# EasyEDA Pro project EP4CE144.eprj (continued)
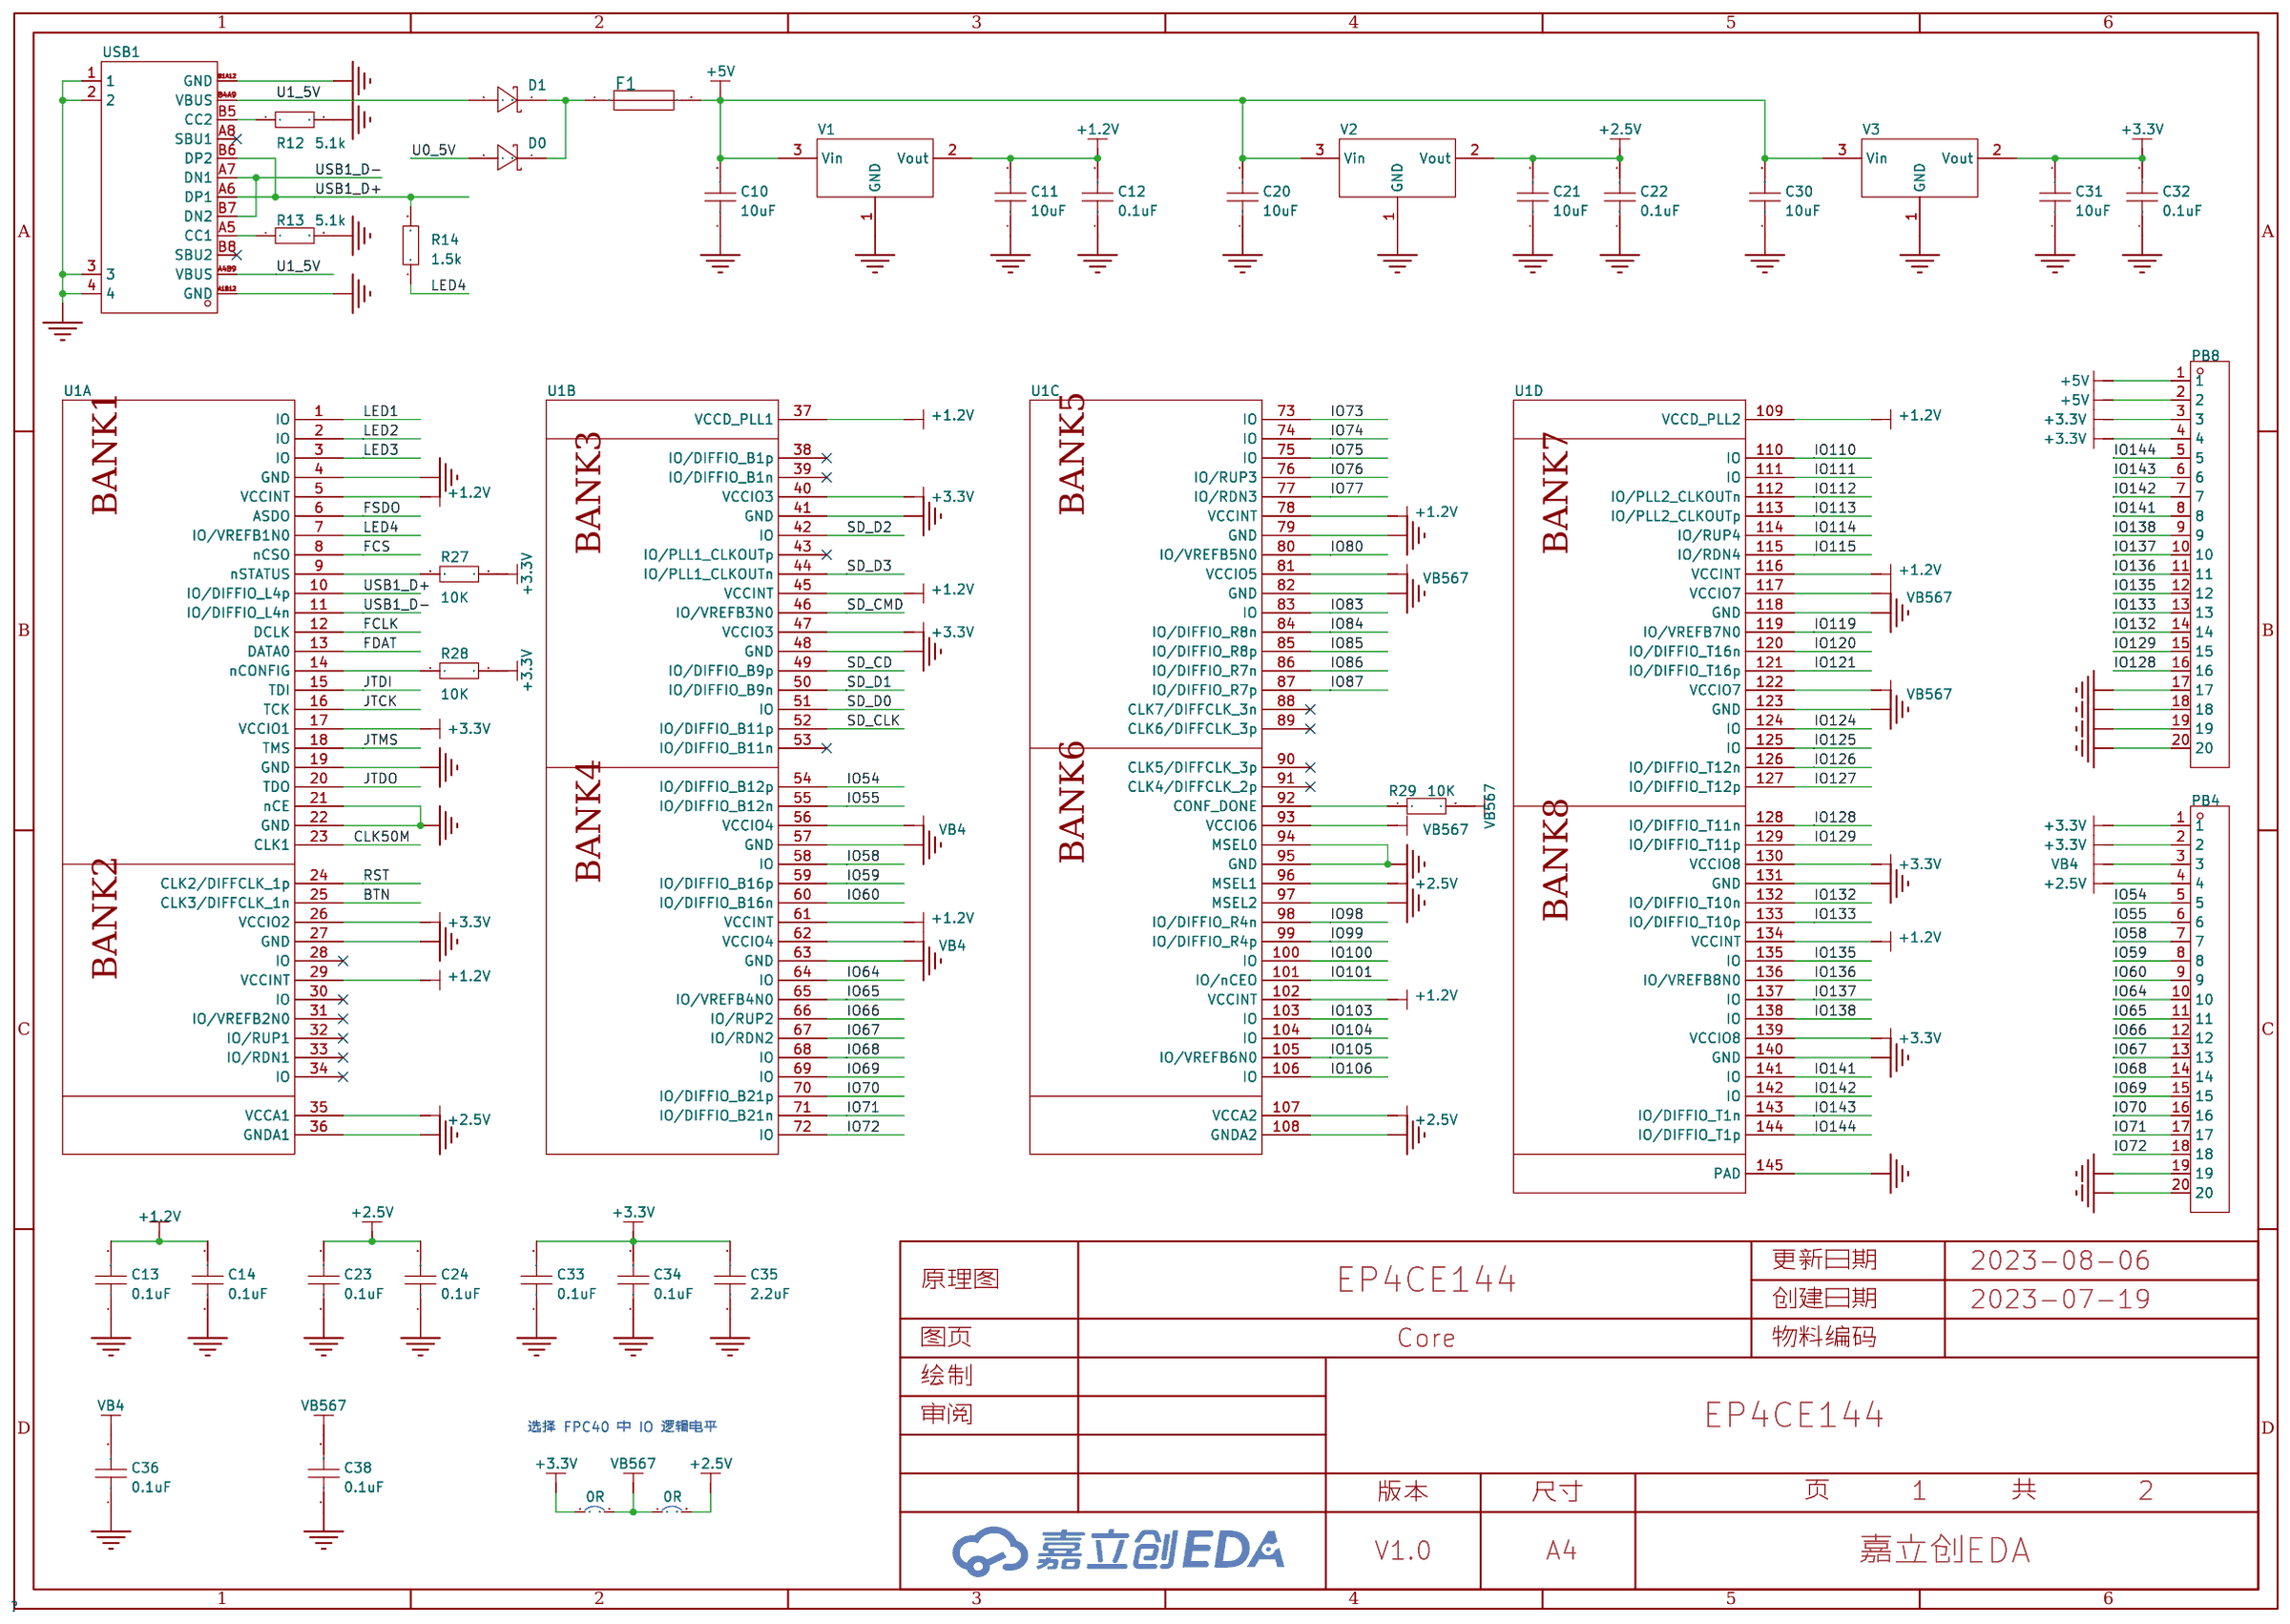
[diagram p0: Core]
## Notes on the sheets (continued)

Outline 60.96 x 45.72 mm; copper layers: Top Layer, Bottom Layer. Coordinates in mm from the lower left corner of the outline.
Outline path: 0,44.2 0,1.52 arc(0.45,0.45) 1.52,0 59.44,0 arc(60.51,0.45) 60.96,1.52 60.96,44.2 arc(60.51,45.27) 59.44,45.72 1.52,45.72 arc(0.45,45.27) 0,44.2
Stack: Top Layer 0.035mm / Dielectric1 1.51mm FR4 er 4.5 / Bottom Layer 0.035mm

## Design rules (mm)
spacing safeClearance (default): track to track 0.152, other pairs 0.152 to 0.3
track width trackWidth (default): min 0.127, default 0.254, max 2.54
differential pair differentialPair (default): width min 0.127, default 0.254, max 2.54; gap min 0.152, default 0.152
via viaSize (default): diameter min 0.5, default 0.61, max 10; hole min 0.3, default 0.305, max 6

## Placement (name value [footprint] x y rotation side)
BTN  PTS815SJK250SMTRLFS  [SW-SMD_4P-L4.2-W3.3-P2.15-LS5.1]  57.78 6.98 0 top
C1  0.1uF  [C0603]  13.21 19.43 0 top
C2  0.1uF  [C0603]  18.03 17.02 180 top
C5  2.2uF  [C0603]  48.77 24.13 90 bottom
C6  2.2uF  [C0603]  51.56 29.46 0 top
C7  2.2uF  [C0603]  51.56 27.56 0 top
C8  0.1uF  [C0603]  19.81 5.97 90 top
C9  1uF  [C0603]  18.03 5.97 90 top
C10  10uF  [C0603]  1.78 18.03 90 top
C11  10uF  [C0603]  1.78 14.99 90 top
C12  0.1uF  [C0603]  9.27 15.75 90 top
C13  0.1uF  [C0603]  24.13 6.98 90 top
C14  0.1uF  [C0603]  47.5 33.66 180 top
C20  10uF  [C0603]  1.78 24.38 90 top
C21  10uF  [C0603]  1.78 21.34 90 top
C22  0.1uF  [C0603]  9.27 22.1 90 top
C23  0.1uF  [C0603]  26.29 6.98 90 top
C24  0.1uF  [C0603]  48.26 31.88 180 top
C30  10uF  [C0603]  1.78 30.73 90 top
C31  10uF  [C0603]  1.78 27.69 90 top
C32  0.1uF  [C0603]  9.27 28.45 90 top
C33  0.1uF  [C0603]  21.97 6.98 90 top
C34  0.1uF  [C0603]  28.45 6.98 90 top
C35  2.2uF  [C0603]  23.24 38.61 0 top
C36  0.1uF  [C0603]  46.35 6.1 180 top
C38  0.1uF  [C0603]  46.35 7.87 180 top
D0  1N5818W  [SOD-123FL_L2.8-W1.8-LS3.7-RD]  9.27 12.7 270 bottom
D1  1N5818W  [SOD-123FL_L2.8-W1.8-LS3.7-RD]  9.27 33.02 90 bottom
F1  JK-nSMD050-30  [F1206]  7.75 22.86 180 bottom
FPC  AFC01-S40FCA-00  [FPC-SMD_P0.50-40P_FGS-XJ-H2.0]  56.26 28.19 270 top
J1  0R  [R0603]  57.91 31.88 90 bottom
J2  0R  [R0603]  57.91 34.92 90 bottom
JTAG  -  [LED0603-RD]  16.26 30.48 180 top
LED1  -  [LED0603-RD_BLUE]  16.26 38.61 180 top
LED2  -  [LED0603-RD_BLUE]  16.26 36.58 180 top
LED3  -  [LED0603-RD_BLUE]  16.26 34.54 180 top
LED4  -  [LED0603-RD_BLUE]  16.26 32.51 180 top
NOREF  -  [Pad_e58]  34.29 22.86 0 top
PB4  -  [HDR-TH_20P-P2.54-V-M-1]  35.56 1.27 0 top
PB8  -  [HDR-TH_20P-P2.54-V-M-1]  35.56 44.32 0 top
PWR  -  [LED0603-RD_BLUE]  16.26 28.45 180 top
R0  1k  [R0603]  12.7 28.45 180 top
R1  1k  [R0603]  12.7 30.48 180 top
R2  1k  [R0603]  12.7 38.61 180 top
R3  1k  [R0603]  12.7 36.58 180 top
R4  1k  [R0603]  12.7 34.54 180 top
R5  1k  [R0603]  12.7 32.51 180 top
R6  10k  [R0603]  46.35 11.05 180 top
R7  10k  [R0603]  46.35 9.53 180 top
R8  10k  [R0603]  19.81 9.02 90 top
R9  10k  [R0603]  18.03 9.02 90 top
R10  5.1k  [R0603]  6.1 1.02 0 top
R11  5.1k  [R0603]  3.05 1.02 180 top
R12  5.1k  [R0603]  3.05 44.7 180 top
R13  5.1k  [R0603]  6.1 44.7 0 top
R14  1.5k  [R0603]  11.94 32.51 270 bottom
R17  200  [R0603]  14.22 13.97 270 top
R18  200  [R0603]  12.7 13.97 270 top
R19  200  [R0603]  11.18 13.97 270 top
R20  47k  [R0603]  58.04 24.13 90 bottom
R21  47k  [R0603]  56.51 24.13 90 bottom
R22  47k  [R0603]  54.99 24.13 90 bottom
R23  47k  [R0603]  53.47 24.13 90 bottom
R24  47k  [R0603]  51.94 24.13 90 bottom
R25  47k  [R0603]  50.42 24.13 90 bottom
R27  10K  [R0603]  23.24 36.96 0 top
R28  10K  [R0603]  23.24 35.43 0 top
R29  10K  [R0603]  47.75 22.86 90 top
RST  PTS815SJK250SMTRLFS  [SW-SMD_4P-L4.2-W3.3-P2.15-LS5.1]  57.78 12.06 0 top
TF  TF-01  [TF-SMD_TF-02]  54.36 12.7 270 bottom
TPC  -  [TP]  12.7 8.89 180 bottom
TPD  -  [TP]  10.92 8.89 180 bottom
U0  -  [TSSOP-20_L6.5-W4.4-P0.65-LS6.4-BL]  13.46 8 180 top
U1  -  [EQFP-144_L20.0-W20.0-P0.50-LS22.0-TL-EP6.7]  34.29 22.86 0 top
U2  EPCS16  [SOIC-8_L4.9-W3.9-P1.27-LS6.0-BL]  15.62 23.24 270 top
USB0  USB-TYPE-C-017  [USB-TYPE-C-SMD_C9900008089]  4.95 6.98 270 top
USB1  USB-TYPE-C-017  [USB-TYPE-C-SMD_C9900008089]  4.95 38.73 270 top
V1  AMS1117-1.2 SOT-89  [SOT-89-3_L4.5-W2.5-P1.50-LS4.2-BR]  5.84 16.51 0 top
V2  AMS1117-2.5 SOT-89  [SOT-89-3_L4.5-W2.5-P1.50-LS4.2-BR]  5.84 22.86 0 top
V3  AMS1117-3.3  [SOT-89-3_L4.5-W2.5-P1.50-LS4.2-BR]  5.84 29.21 0 top
X50M  50MHz  [OSC-SMD_4P-L3.2-W2.5-BL]  18.41 14.22 0 top

## Footprints (pads in the part's own frame, mm; a bottom-side part is the same pattern mirrored in y, then rotated)
C0603
  rect 0.8x0.9 smd: 1(-0.7,0) 2(0.7,0)
EQFP-144_L20.0-W20.0-P0.50-LS22.0-TL-EP6.7
  oval 1.66x0.28 smd: 1(-10.58,8.75) 2(-10.58,8.25) 3(-10.58,7.75) 4(-10.58,7.25) 5(-10.58,6.75) 6(-10.58,6.25) 7(-10.58,5.75) 8(-10.58,5.25) 9(-10.58,4.75) 10(-10.58,4.25) 11(-10.58,3.75) 12(-10.58,3.25) 13(-10.58,2.75) 14(-10.58,2.25) 15(-10.58,1.75) 16(-10.58,1.25) 17(-10.58,0.75) 18(-10.58,0.25) 19(-10.58,-0.25) 20(-10.58,-0.75) 21(-10.58,-1.25) 22(-10.58,-1.75) 23(-10.58,-2.25) 24(-10.58,-2.75) 25(-10.58,-3.25) 26(-10.58,-3.75) 27(-10.58,-4.25) 28(-10.58,-4.75) 29(-10.58,-5.25) 30(-10.58,-5.75) 31(-10.58,-6.25) 32(-10.58,-6.75) 33(-10.58,-7.25) 34(-10.58,-7.75) 35(-10.58,-8.25) 36(-10.58,-8.75) 73(10.58,-8.75) 74(10.58,-8.25) 75(10.58,-7.75) 76(10.58,-7.25) 77(10.58,-6.75) 78(10.58,-6.25) 79(10.58,-5.75) 80(10.58,-5.25) 81(10.58,-4.75) 82(10.58,-4.25) 83(10.58,-3.75) 84(10.58,-3.25) 85(10.58,-2.75) 86(10.58,-2.25) 87(10.58,-1.75) 88(10.58,-1.25) 89(10.58,-0.75) 90(10.58,-0.25) 91(10.58,0.25) 92(10.58,0.75) 93(10.58,1.25) 94(10.58,1.75) 95(10.58,2.25) 96(10.58,2.75) 97(10.58,3.25) 98(10.58,3.75) 99(10.58,4.25) 100(10.58,4.75) 101(10.58,5.25) 102(10.58,5.75) 103(10.58,6.25) 104(10.58,6.75) 105(10.58,7.25) 106(10.58,7.75) 107(10.58,8.25) 108(10.58,8.75)
  oval 0.28x1.66 smd: 37(-8.75,-10.58) 38(-8.25,-10.58) 39(-7.75,-10.58) 40(-7.25,-10.58) 41(-6.75,-10.58) 42(-6.25,-10.58) 43(-5.75,-10.58) 44(-5.25,-10.58) 45(-4.75,-10.58) 46(-4.25,-10.58) 47(-3.75,-10.58) 48(-3.25,-10.58) 49(-2.75,-10.58) 50(-2.25,-10.58) 51(-1.75,-10.58) 52(-1.25,-10.58) 53(-0.75,-10.58) 54(-0.25,-10.58) 55(0.25,-10.58) 56(0.75,-10.58) 57(1.25,-10.58) 58(1.75,-10.58) 59(2.25,-10.58) 60(2.75,-10.58) 61(3.25,-10.58) 62(3.75,-10.58) 63(4.25,-10.58) 64(4.75,-10.58) 65(5.25,-10.58) 66(5.75,-10.58) 67(6.25,-10.58) 68(6.75,-10.58) 69(7.25,-10.58) 70(7.75,-10.58) 71(8.25,-10.58) 72(8.75,-10.58) 109(8.75,10.58) 110(8.25,10.58) 111(7.75,10.58) 112(7.25,10.58) 113(6.75,10.58) 114(6.25,10.58) 115(5.75,10.58) 116(5.25,10.58) 117(4.75,10.58) 118(4.25,10.58) 119(3.75,10.58) 120(3.25,10.58) 121(2.75,10.58) 122(2.25,10.58) 123(1.75,10.58) 124(1.25,10.58) 125(0.75,10.58) 126(0.25,10.58) 127(-0.25,10.58) 128(-0.75,10.58) 129(-1.25,10.58) 130(-1.75,10.58) 131(-2.25,10.58) 132(-2.75,10.58) 133(-3.25,10.58) 134(-3.75,10.58) 135(-4.25,10.58) 136(-4.75,10.58) 137(-5.25,10.58) 138(-5.75,10.58) 139(-6.25,10.58) 140(-6.75,10.58) 141(-7.25,10.58) 142(-7.75,10.58) 143(-8.25,10.58) 144(-8.75,10.58)
  rect 6.7x6.7 smd: 145(0,0)
F1206
  rect 1.19x1.728 smd: 1(-1.445,0) 2(1.445,0)
FPC-SMD_P0.50-40P_FGS-XJ-H2.0
  rect 0.3x1.3 smd: 1(-9.75,-1.3) 2(-9.25,-1.3) 3(-8.75,-1.3) 4(-8.25,-1.3) 5(-7.75,-1.3) 6(-7.25,-1.3) 7(-6.75,-1.3) 8(-6.25,-1.3) 9(-5.75,-1.3) 10(-5.25,-1.3) 11(-4.75,-1.3) 12(-4.25,-1.3) 13(-3.75,-1.3) 14(-3.25,-1.3) 15(-2.75,-1.3) 16(-2.25,-1.3) 17(-1.75,-1.3) 18(-1.25,-1.3) 19(-0.75,-1.3) 20(-0.25,-1.3) 21(0.25,-1.3) 22(0.75,-1.3) 23(1.25,-1.3) 24(1.75,-1.3) 25(2.25,-1.3) 26(2.75,-1.3) 27(3.25,-1.3) 28(3.75,-1.3) 29(4.25,-1.3) 30(4.75,-1.3) 31(5.25,-1.3) 32(5.75,-1.3) 33(6.25,-1.3) 34(6.75,-1.3) 35(7.25,-1.3) 36(7.75,-1.3) 37(8.25,-1.3) 38(8.75,-1.3) 39(9.25,-1.3) 40(9.75,-1.3)
  rect 2x1.6 smd: 41(11.45,1.3) 42(-11.45,1.3)
HDR-TH_20P-P2.54-V-M-1
  rect 1.801x1.801 hole 1.199: 1(-24.13,0)
  round 1.801 hole 1.199: 2(-21.59,0) 3(-19.05,0) 4(-16.51,0) 5(-13.97,0) 6(-11.43,0) 7(-8.89,0) 8(-6.35,0) 9(-3.81,0) 10(-1.27,0) 11(1.27,0) 12(3.81,0) 13(6.35,0) 14(8.89,0) 15(11.43,0) 16(13.97,0) 17(16.51,0) 18(19.05,0) 19(21.59,0) 20(24.13,0)
LED0603-RD
  rect 0.8x0.8 smd: 1(-0.799,-0.004) 2(0.799,0.004)
LED0603-RD_BLUE
  rect 0.8x0.8 smd: 1(-0.8,-0.003) 2(0.8,0.003)
OSC-SMD_4P-L3.2-W2.5-BL
  rect 1.4x1.2 smd: 1(-1.1,-0.875) 2(1.1,-0.875) 3(1.1,0.875) 4(-1.1,0.875)
Pad_e58
  round 3.048 hole 2.032: 1(0,0)
R0603
  rect 0.806x0.864 smd: 1(-0.753,0) 2(0.753,0)
SOD-123FL_L2.8-W1.8-LS3.7-RD
  rect 1.2x1.2 smd: 1(-1.6,0) 2(1.6,0)
SOIC-8_L4.9-W3.9-P1.27-LS6.0-BL
  oval 0.588x2.045 smd: 1(-1.905,-2.772) 2(-0.635,-2.772) 3(0.635,-2.772) 4(1.905,-2.772) 5(1.905,2.772) 6(0.635,2.772) 7(-0.635,2.772) 8(-1.905,2.772)
SOT-89-3_L4.5-W2.5-P1.50-LS4.2-BR
  rect 1.575x0.672 smd: 1(1.356,-1.5) 3(1.356,1.5)
  custom 0x0 smd: 2(-1.356,0)
SW-SMD_4P-L4.2-W3.3-P2.15-LS5.1
  rect 1.3x0.701 smd: 1(-2.251,1.075) 2(2.251,1.075) 3(-2.251,-1.075) 4(2.251,-1.075)
TF-SMD_TF-02
  rect 0.7x1.6 smd: 1(2.245,5.3) 2(1.145,5.3) 3(0.046,5.3) 4(-1.054,5.3) 5(-2.155,5.3) 6(-3.255,5.3) 7(-4.354,5.3) 8(-5.454,5.3) 9(-6.554,5.3)
  rect 1.2x1.5 smd: 10(-7.754,4.3)
  rect 1.2x2.2 smd: 11(-7.746,-5.3) 12(7.754,-5.3)
  rect 1.6x1.5 smd: 13(6.854,4.3)
TP
  round 1.016 smd: 1(0,0)
TSSOP-20_L6.5-W4.4-P0.65-LS6.4-BL
  oval 0.364x1.742 smd: 1(-2.925,-2.871) 2(-2.275,-2.871) 3(-1.625,-2.871) 4(-0.975,-2.871) 5(-0.325,-2.871) 6(0.325,-2.871) 7(0.975,-2.871) 8(1.625,-2.871) 9(2.275,-2.871) 10(2.925,-2.871) 11(2.925,2.871) 12(2.275,2.871) 13(1.625,2.871) 14(0.975,2.871) 15(0.325,2.871) 16(-0.325,2.871) 17(-0.975,2.871) 18(-1.625,2.871) 19(-2.275,2.871) 20(-2.925,2.871)
USB-TYPE-C-SMD_C9900008089
  oval 1x2.1 hole 0.6x1.7: 1(-4.32,1.801) 2(4.32,1.801)
  oval 1x1.8 hole 0.6x1.4: 3(-4.32,-2.379) 4(4.32,-2.379)
  rect 0.6x1.3 smd: A1B12(-3.2,2.379) A4B9(-2.4,2.379) B1A12(3.2,2.379) B4A9(2.4,2.379)
  rect 0.3x1.3 smd: A5(-1.25,2.379) A6(-0.25,2.379) A7(0.25,2.379) A8(1.25,2.379) B5(1.75,2.379) B6(0.75,2.379) B7(-0.75,2.379) B8(-1.75,2.379)

## Nets
As in the schematic, except:
GND: BTN.1 BTN.2 C1.1 C2.1 C5.1 C6.1 C7.1 C8.1 C9.1 C10.1 C11.1 C12.1 C13.1 C14.1 C20.1 C21.1 C22.1 C23.1 C24.1 C30.1 C31.1 C32.1 C33.1 C34.1 C35.1 C36.1 C38.1 FPC.19 FPC.20 FPC.21 FPC.41 FPC.42 JTAG.1 LED1.1 LED2.1 LED3.1 LED4.1 NOREF.1 PB4.19 PB4.20 PB8.17 PB8.18 PB8.19 PB8.20 PWR.1 R8.1 R10.2 R11.2 R12.2 R13.2 RST.1 RST.2 TF.6 TF.10 TF.11 TF.12 TF.13 U0.15 U1.4 U1.19 U1.21 U1.22 U1.27 U1.36 U1.41 U1.48 U1.57 U1.63 U1.79 U1.82 U1.94 U1.95 U1.97 U1.108 U1.118 U1.123 U1.131 U1.140 U1.145 U2.4 USB0.1 USB0.2 USB0.3 USB0.4 USB0.A1B12 USB0.B1A12 USB1.1 USB1.2 USB1.3 USB1.4 USB1.A1B12 USB1.B1A12 V1.1 V2.1 V3.1 X50M.2

Pads without a net: FPC 14; U0 2 3 11 12 13 14; U1 28 30 31 32 33 34 38 39 43 53 88 89 90 91; USB0 A8 B8; USB1 A8 B8

## Via types
v1: diameter 0.813, hole 0.305, Top Layer to Bottom Layer, 24 vias
v2: diameter 0.61, hole 0.305, Top Layer to Bottom Layer, 44 vias
v3: diameter 0.508, hole 0.305, Top Layer to Bottom Layer, 44 vias
v4: diameter 0.686, hole 0.305, Top Layer to Bottom Layer, 3 vias

## Routing (per net, layer and track width the routed paths; a pad name or vN(x,y) marks a point on that pad's centre or on a via; arc(x,y) is an arc through that point)
+1.2V: length 129.7
  Top Layer w0.203: v3(43.18,14.22) 43.18,16.38 43.41,16.61 U1.78 ; U1.61 37.54,13.26 v3(37.08,13.72) ; v3(41.53,14.22) v2(41.53,17.4)
  Top Layer w0.305: U1.116 39.54,32.22 43.04,28.72 ; 43.04,28.72 U1.109 43.26,33.66 C14.2 ; 43.04,28.72 v2(43.15,28.61) U1.102 ; 29.54,17.61 41.32,17.61 v2(41.53,17.4) 41.53,27.18 v2(40.13,28.58) 39.1,29.61 U1.5 ; 29.54,17.61 25.06,17.61 ; 29.54,17.61 29.54,17.61 U1.45 ; U1.37 25.54,17.13 25.06,17.61 ; 25.06,17.61 U1.29 v2(22.31,17.61) 22.31,17.61 21.97,17.27 21.97,9.84 C13.2 ; C12.2 10.38,16.45 v2(10.41,16.42) ; U1.134 30.54,29.61
  Top Layer w0.508: C12.2 9.21,16.51 V1.2 3.66,15.69 C11.2
  Bottom Layer w0.203: v3(43.18,14.22) v3(41.53,14.22) 37.59,14.22 v3(37.08,13.72)
  Bottom Layer w0.305: v2(10.41,16.42) 11.61,17.61 v2(22.31,17.61) ; v2(40.13,28.58) 40.17,28.61 v2(43.15,28.61)
+2.5V: length 120
  Top Layer w0.305: 24.1,9.88 22.48,11.5 22.48,14.35 22.74,14.61 U1.35 ; 24.1,9.88 24.12,9.91 v2(24.13,9.91) ; 24.1,9.88 C23.2 ; U1.96 46.18,25.61 v2(46.23,25.65) ; v2(25.53,18.29) 39.75,18.29 40.64,19.18 v2(40.64,25.65) ; v2(24.13,4.44) 22.22,4.44 PB4.4 ; U1.107 45.84,31.11 v2(46.61,31.88) C24.2
  Top Layer w0.508: 9.21,22.86 C22.2 ; 9.21,22.86 V2.2 3.66,22.04 C21.2 ; 9.21,22.86 v1(10.67,22.86)
  Bottom Layer w0.305: 46.23,28.45 50.29,28.45 57.52,35.68 J2.2 ; 46.23,28.45 v2(46.23,25.65) v2(40.64,25.65) ; 46.23,28.45 46.23,31.5 v2(46.61,31.88) ; v2(24.13,4.44) v2(24.13,9.91) ; v2(24.13,9.91) 21.46,12.57 8.64,12.57 7.75,13.46 v1(7.75,22.86) ; v2(24.13,9.91) 24.13,16.89 v2(25.53,18.29)
+3.3V: length 299.7
  Top Layer w0.203: R0.2 12.96,29.46 v3(16,29.46) ; U1.40 27.04,9.09 C34.2 ; R9.2 18.92,8.88 18.92,7.56 C8.2
  Top Layer w0.305: U1.26 v2(22.28,19.11) 21.46,18.29 21.46,8.19 C33.2 ; 13.79,10.87 13.79,9.83 v2(15.62,8) ; C2.2 17.31,17 X50M.4 X50M.1 17.4,13.27 v2(17.4,11.81) ; v2(32.26,35.43) 32.54,35.15 U1.130 ; U1.139 28.04,41.88 v1(28.7,42.55) ; U1.17 23.72,23.62 v2(25.15,23.62) ; v2(14.73,19.43) C1.2 ; v2(27.69,35.56) 28.04,35.56 ; v2(30.23,14.61) 30.54,14.29 U1.47 ; U1.40 27.04,14.21 v2(27.43,14.61) ; U2.7 19.94,23.88 v2(20.19,23.62) ; 13.79,5.13 v2(13.79,6.16)
  Top Layer w0.381: 14.99,22.61 v4(16.26,23.88) U2.7 ; 14.99,22.61 14.99,20.51 C1.2 ; 14.99,22.61 U2.3 12.19,22.61 8.38,26.42 v4(8,26.42) ; U2.8 v4(16.26,25.15) ; PB4.2 13.79,1.45 13.79,5.13
  Top Layer w0.508: R28.2 R27.2 23.99,39.38 PB8.4 ; R7.2 R6.2 45.6,12.71 v1(46.1,13.21) ; v1(10.54,40) 12.19,40 PB8.3 ; C31.2 3.66,28.39 V3.2 9.21,29.21 C32.2
  Bottom Layer w0.203: v3(16,29.46) 16.26,29.21 v4(16.26,25.15)
  Bottom Layer w0.254: TF.4 52.49,13.75 54.23,15.49 54.23,24.87 54.24,24.88
  Bottom Layer w0.305: 15.62,8 17.39,9.77 v2(17.4,9.77) v2(17.4,11.81) ; 15.62,8 v2(15.62,8) ; 15.62,8 15.5,7.87 ; v2(20.19,23.62) v2(25.15,23.62) 26.92,23.62 27.43,23.11 v2(27.43,14.61) v2(30.23,14.61) ; v2(14.73,19.43) 21.96,19.43 v2(22.28,19.11) ; v2(27.69,35.56) 32.13,35.56 v2(32.26,35.43) ; 15.5,7.87 v2(13.79,6.16) ; 15.5,7.87 15.49,7.87
  Bottom Layer w0.381: v1(8,29.21) v4(8,26.42) ; v4(16.26,25.15) v4(16.26,23.88)
  Bottom Layer w0.508: PB8.3 PB8.4 20.83,42.55 v1(28.7,42.55) 57.28,42.55 59.18,40.64 59.18,31.13 ; C5.2 48.82,24.88 R25.2 R24.2 R23.2 R22.2 R21.2 R20.2 59.18,26.03 59.18,31.13 ; TF.4 46.65,13.75 v1(46.1,13.21) ; 59.18,31.13 59.18,31.12 J1.1 ; v1(10.54,40) 10.54,33.78 9.78,33.02 8.64,33.02 8,32.39 v1(8,29.21) ; v1(2.54,28.39) 0.64,26.48 0.64,2.41 1.78,1.27 PB4.1 PB4.2
+5V: length 119.4
  Top Layer w0.508: V2.3 v1(6.47,25.08) C20.2 ; v1(56.51,37.85) 56.51,30.23 56.01,29.72 52.52,29.72 C6.2 ; C10.2 v1(6.47,18.73) V1.3 ; V3.3 v1(6.47,31.43) C30.2
  Bottom Layer w0.508: v1(6.47,18.73) v1(6.47,25.08) v1(6.47,31.43) 2.35,31.43 0.64,33.15 0.64,43.31 1.65,44.32 PB8.1 PB8.2 16.89,41.4 55.75,41.4 56.51,40.64 v1(56.51,37.85)
GND: length 529.3
  Top Layer w0.203: X50M.2 19.29,13.35 18.41,14.22 18.41,16.7 C2.1 ; U1.27 24.71,18.61 v3(25.15,19.05) ; U1.63 38.54,13.39 v3(38.74,13.59) ; v3(25.15,21.59) 25.15,21.6 25.14,21.61
  Top Layer w0.305: 17.06,30.11 U1.4 26.94,30.11 v2(27.54,30.72) U1.140 ; v2(43.31,24.89) 43.31,24.92 ; 43.31,24.92 43.61,24.61 U1.94 U1.95 ; 43.31,24.92 43.31,25.81 43.61,26.11 U1.97 ; U1.131 32.04,31.21 v2(32.51,30.73) 35.56,30.73 36.04,31.21 U1.123 ; FPC.21 FPC.20 FPC.19 ; v2(20.7,13.33) 20.69,13.35 X50M.2 ; v2(43.31,17.4) 43.6,17.11 U1.79 ; U1.19 34.04,22.61 ; 34.04,22.61 33.04,21.61 28.47,21.61 ; 34.04,22.61 U1.145 ; U1.36 23.71,13.68 v2(23.37,13.33) ; v2(30.35,16.76) 31.04,16.08 U1.48 ; U1.57 35.54,13.31 v2(35.94,13.72) ; 28.47,21.61 v2(28.45,21.59) ; 28.47,21.61 U1.21 U1.22 ; v2(28.45,16.76) 28.45,14.35 27.54,13.44 U1.41 ; U1.82 43.62,18.61 v2(43.31,18.92) ; U2.4 13.08,21.34 v2(13.59,20.83) ; U1.118 38.54,34.98 v2(38.86,35.31) ; v1(48.96,32.89) 48.83,32.77 46.03,32.77 U1.108
  Top Layer w0.381: FPC.20 50.87,28.44 50.86,28.45 ; USB0.B1A12 7.56,3.56 12.83,3.56 13.14,3.87 U0.15 ; 20.84,7.24 21.79,6.28 C33.1 ; 20.84,7.24 20.84,12.02 X50M.2 ; 20.84,7.24 R8.1
  Top Layer w0.508: 0.64,14.29 C11.1 6.47,14.29 V1.1 9.23,15.01 C12.1 ; 0.64,14.29 0.64,20.64 ; 0.64,14.29 0.64,2.68 0.65,2.67 ; USB1.A1B12 7.33,42.48 USB1.1 6.75,44.61 R13.2 ; PB8.18 53.97,43.69 v1(53.97,40.26) 56.95,40.26 FPC.42 ; PB8.18 PB8.19 PB8.20 ; PB8.18 PB8.17 ; 0.64,20.64 0.64,26.98 ; 0.64,20.64 C21.1 6.47,20.64 V2.1 9.23,21.36 C22.1 9.33,21.34 U2.4 12.51,21 C1.1 ; USB0.1 7.33,10.73 USB0.A1B12 ; BTN.2 BTN.1 55.3,8.06 v1(54.61,7.37) ; C20.1 0.64,23.68 ; C7.1 C6.1 v1(49.4,29.46) ; LED1.1 v1(17.06,40.2) ; LED1.1 LED2.1 LED3.1 LED4.1 JTAG.1 PWR.1 ; LED1.1 22.54,38.61 22.54,38.61 ; RST.1 58.93,13.14 ; 58.93,13.14 58.93,13.14 v1(58.93,13.84) 58.93,16.38 58.57,16.74 FPC.41 56.82,16 v1(52.58,16) ; 58.93,13.14 RST.2 ; 0.65,43.06 0.64,43.04 0.64,30.04 ; 0.65,43.06 USB1.3 ; 0.65,43.06 0.65,43.32 2.03,44.7 R12.2 ; USB0.4 0.65,2.67 ; 0.65,2.67 0.65,2.4 2.03,1.02 R11.2 ; 0.64,26.98 6.47,26.98 V3.1 9.23,27.71 C32.1 ; 0.64,26.98 0.64,30.04 ; R10.2 6.75,1.11 USB0.2 7.33,3.24 USB0.B1A12 ; USB0.3 0.64,11.31 ; C24.1 v1(48.96,32.89) C14.1 ; 0.64,30.04 0.64,30.03 C30.1 ; C10.1 0.64,17.33 ; 47.06,7.87 47.06,6.1 47.31,5.84 v1(51.31,5.84) ; USB1.B1A12 7.33,34.99 6.75,34.42 ; 2.57,34.42 0.64,34.42 ; v1(17.27,3.56) 17.27,4.51 C9.1 C8.1 20.96,5.27 C33.1 C13.1 C23.1 C34.1
  Bottom Layer w0.203: v3(25.15,19.05) v3(25.15,21.59) ; v3(38.74,13.59) 38.23,13.08 36.58,13.08 v2(35.94,13.72)
  Bottom Layer w0.305: v2(38.86,35.31) 38.86,40.26 ; v2(43.31,24.89) v2(43.31,18.92) v2(43.31,17.4) ; v2(43.31,24.89) 41.28,22.86 U1.145 ; v2(43.31,24.89) 44.77,23.43 C5.1 ; v2(23.37,13.33) v2(20.7,13.33) ; v2(32.51,30.73) 32.49,30.72 v2(27.54,30.72) ; v2(28.45,21.59) v2(28.45,16.76) v2(30.35,16.76) 31.12,16 31.12,13.97 31.37,13.72 v2(35.94,13.72) ; v2(13.59,20.83) 24.38,20.83 v3(25.15,21.59)
  Bottom Layer w0.508: 47.77,3.56 v1(17.27,3.56) 7.64,3.56 USB0.2 USB0.4 ; 47.77,3.56 TF.13 50.06,5.84 v1(51.31,5.84) 53.09,5.84 v1(54.61,7.37) ; 47.77,3.56 54.86,3.56 ; PB8.20 60.2,43.81 60.2,20.99 TF.11 58.93,19.72 v1(58.93,13.84) ; TF.10 48.77,21.74 C5.1 ; 48.96,40.26 11.94,40.26 9.14,43.06 USB1.1 USB1.3 ; 48.96,40.26 48.96,40.26 v1(48.96,32.89) 48.96,29.91 v1(49.4,29.46) ; 48.96,40.26 v1(53.97,40.26) ; v1(52.58,16) 49.1,16 TF.6 ; TF.12 58.27,3.56 54.86,3.56 ; 54.86,3.56 PB4.19 PB4.20 ; USB0.3 USB0.1 ; 2.57,34.42 6.75,34.42
BTN: length 53.6
  Top Layer w0.203: v3(26.16,19.43) 25.98,19.61 U1.25 ; BTN.4 BTN.3 54.41,5.91 v3(52.07,8.25) 50.8,9.53 R7.1
  Bottom Layer w0.203: v3(52.07,8.25) 51.94,8.38 26.8,8.38 26.16,9.02 v3(26.16,19.43)
CLK50M: length 7.9
  Top Layer w0.203: X50M.3 20.07,15.65 20.07,18.03 22.64,20.61 U1.23
FCLK: length 8.7
  Top Layer w0.203: U1.12 19.63,26.11 v3(19.43,25.91) ; v3(19.43,22.61) U2.6
  Bottom Layer w0.203: v3(19.43,25.91) v3(19.43,22.61)
FCS: length 13.1
  Top Layer w0.203: U1.8 18.2,28.11 v3(17.91,27.81) ; U2.1 13.74,26.03 v3(17.91,26.03)
  Bottom Layer w0.203: v3(17.91,27.81) v3(17.91,26.03)
FDAT: length 11.6
  Top Layer w0.203: U1.13 21.93,25.61 20.83,24.51 14.73,24.51 14.1,23.88 U2.2
FSDO: length 13.2
  Top Layer w0.203: U1.6 19.02,29.11 v3(18.8,29.34) ; U2.5 18.41,21.34 v3(18.8,21.72)
  Bottom Layer w0.203: v3(18.8,29.34) v3(18.8,21.72)
IO54: length 19.3
  Top Layer w0.203: U1.54 34.04,8.39 29.34,3.68 24,3.68 PB4.5
IO55: length 17.4
  Top Layer w0.203: U1.55 34.54,8.12 29.59,3.17 26.03,3.17 PB4.6
IO58: length 15.9
  Top Layer w0.203: U1.58 36.04,8.86 29.84,2.67 28.07,2.67 PB4.7
IO59: length 14
  Top Layer w0.203: U1.59 36.54,8.6 PB4.8
IO60: length 13.2
  Top Layer w0.203: PB4.9 37.04,6.56 U1.60
IO64: length 13.5
  Top Layer w0.203: U1.64 39.04,5.13 36.58,2.67 35.69,2.67 PB4.10
IO65: length 12.1
  Top Layer w0.203: U1.65 39.54,3.98 PB4.11
IO66: length 11.3
  Top Layer w0.203: U1.66 40.04,1.94 PB4.12
IO67: length 11.6
  Top Layer w0.203: PB4.13 40.54,2.64 U1.67
IO68: length 12.4
  Top Layer w0.203: U1.68 41.04,4.68 PB4.14
IO69: length 13.9
  Top Layer w0.203: U1.69 41.54,5.58 44.45,2.67 45.59,2.67 PB4.15
IO70: length 15.8
  Top Layer w0.203: U1.70 42.04,5.84 44.7,3.17 47.62,3.17 PB4.16
IO71: length 17.7
  Top Layer w0.203: U1.71 42.54,6.1 44.96,3.68 49.66,3.68 PB4.17
IO72: length 19.6
  Top Layer w0.203: U1.72 43.04,6.36 45.21,4.19 51.69,4.19 PB4.18
IO73: length 11.9
  Top Layer w0.203: FPC.40 53.88,18.44 49.54,14.11 U1.73
IO74: length 11.9
  Top Layer w0.203: U1.74 49.28,14.61 53.62,18.94 FPC.39
IO75: length 11.9
  Top Layer w0.203: FPC.38 53.35,19.44 49.02,15.11 U1.75
IO76: length 11.9
  Top Layer w0.203: U1.76 48.76,15.61 53.09,19.94 FPC.37
IO77: length 11.9
  Top Layer w0.203: FPC.36 52.83,20.44 48.5,16.11 U1.77
IO80: length 11.5
  Top Layer w0.203: FPC.35 52.57,20.94 49.23,17.61 U1.80
IO83: length 11.1
  Top Layer w0.203: U1.83 49.97,19.11 52.31,21.44 FPC.34
IO84: length 11.1
  Top Layer w0.203: FPC.33 52.04,21.94 49.71,19.61 U1.84
IO85: length 11.1
  Top Layer w0.203: FPC.32 51.78,22.44 49.45,20.11 U1.85
IO86: length 11.1
  Top Layer w0.203: U1.86 49.19,20.61 51.52,22.94 FPC.31
IO87: length 11.1
  Top Layer w0.203: U1.87 48.92,21.11 51.26,23.44 FPC.30
IO98: length 11.2
  Top Layer w0.203: U1.98 46.41,26.61 49.08,23.94 FPC.29
IO99: length 11.2
  Top Layer w0.203: FPC.28 49.34,24.44 46.68,27.11 U1.99
IO100: length 11.2
  Top Layer w0.203: FPC.27 49.6,24.94 46.94,27.61 U1.100
IO101: length 11.2
  Top Layer w0.203: FPC.26 49.87,25.44 47.2,28.11 U1.101
IO103: length 11.4
  Top Layer w0.203: FPC.25 50.13,25.94 46.96,29.11 U1.103
IO104: length 11.4
  Top Layer w0.203: U1.104 47.22,29.61 50.39,26.44 FPC.24
IO105: length 10.2
  Top Layer w0.203: FPC.16 47.08,30.44 46.75,30.11 U1.105
IO106: length 10.2
  Top Layer w0.203: FPC.15 46.82,30.94 46.49,30.61 U1.106
IO110: length 14.6
  Top Layer w0.203: U1.110 42.54,34.41 42.8,34.67 48.64,34.67 51.37,31.94 FPC.13
IO111: length 15.4
  Top Layer w0.203: FPC.12 51.5,32.44 48.9,35.05 42.42,35.05 42.04,34.67 U1.111
IO112: length 16.2
  Top Layer w0.203: U1.112 41.54,34.94 42.04,35.43 49.15,35.43 51.64,32.94 FPC.11
IO113: length 16.9
  Top Layer w0.203: U1.113 41.04,35.2 41.66,35.81 49.4,35.81 51.77,33.44 FPC.10
IO114: length 17.7
  Top Layer w0.203: FPC.9 51.91,33.94 49.66,36.19 41.28,36.19 40.54,35.46 U1.114
IO115: length 18.4
  Top Layer w0.203: FPC.8 52.04,34.44 49.91,36.58 40.89,36.58 40.04,35.72 U1.115
IO119: length 20.7
  Top Layer w0.203: U1.119 38.04,36.01 38.99,36.96 50.16,36.96 52.18,34.94 FPC.7
IO120: length 21.5
  Top Layer w0.203: U1.120 37.54,36.27 38.61,37.34 50.42,37.34 52.31,35.44 FPC.6
IO121: length 22.2
  Top Layer w0.203: FPC.5 52.45,35.94 50.67,37.72 38.23,37.72 37.04,36.53 U1.121
IO124: length 24
  Top Layer w0.203: FPC.4 52.58,36.44 50.93,38.1 36.83,38.1 35.54,36.81 U1.124
IO125: length 24.8
  Top Layer w0.203: FPC.3 52.72,36.94 51.18,38.48 36.45,38.48 35.04,37.07 U1.125
IO126: length 25.5
  Top Layer w0.203: FPC.2 52.85,37.44 51.44,38.86 36.07,38.86 34.54,37.33 U1.126
IO127: length 26.3
  Top Layer w0.203: FPC.1 52.99,37.94 51.69,39.24 35.69,39.24 34.04,37.6 U1.127
IO128: length 23.1
  Top Layer w0.203: U1.128 33.54,37.86 35.43,39.75 44.96,39.75 PB8.16
IO129: length 21.2
  Top Layer w0.203: PB8.15 42.8,40.13 35.05,40.13 33.04,38.12 U1.129
IO132: length 19.7
  Top Layer w0.203: PB8.14 40.64,40.51 34.67,40.51 31.54,37.38 U1.132
IO133: length 17.8
  Top Layer w0.203: U1.133 31.04,37.64 34.29,40.89 38.48,40.89 PB8.13
IO135: length 16.2
  Top Layer w0.203: U1.135 30.04,37.41 33.91,41.28 36.32,41.28 PB8.12
IO136: length 14.3
  Top Layer w0.203: PB8.11 34.16,41.66 33.53,41.66 29.54,37.67 U1.136
IO137: length 13.1
  Top Layer w0.203: U1.137 29.04,39.07 PB8.10
IO138: length 12.2
  Top Layer w0.203: PB8.9 28.54,41.11 U1.138
IO141: length 11.8
  Top Layer w0.203: U1.141 27.04,42.15 PB8.8
IO142: length 10.9
  Top Layer w0.203: U1.142 26.54,44.19 PB8.7
IO143: length 11.7
  Top Layer w0.203: PB8.6 26.04,42.41 U1.143
IO144: length 12.5
  Top Layer w0.203: U1.144 25.54,40.37 PB8.5
JTCK: length 16.4
  Top Layer w0.203: U1.16 22.46,24.11 20.45,22.1 20.45,20.7 18.54,18.8 15.62,18.8 12.7,15.88 R18.1
JTDI: length 17.7
  Top Layer w0.203: U1.15 22.2,24.61 20.07,22.48 20.07,20.95 18.29,19.18 15.37,19.18 11.18,14.99 R19.1
JTDO: length 18.7
  Top Layer w0.203: U0.6 13.14,11.74 13.84,12.45 14.99,12.45 15.49,12.95 15.49,17.4 16.13,18.03 19.05,18.03 21.21,20.19 21.21,20.83 22.49,22.11 U1.20
JTMS: length 14.8
  Top Layer w0.203: R17.1 14.22,16.76 15.88,18.42 18.8,18.42 20.83,20.45 20.83,21.46 22.47,23.11 U1.18
LED1: length 17.2
  Top Layer w0.203: v3(16.26,37.59) 12.96,37.59 R2.2 ; U1.1 22.11,31.61 21.59,32.13 21.59,36.45 20.45,37.59 v3(17.91,37.59)
  Bottom Layer w0.203: v3(17.91,37.59) v3(16.26,37.59)
LED2: length 15.7
  Top Layer w0.203: R3.2 12.96,35.56 v3(16.26,35.56) ; U1.2 21.85,31.11 21.21,31.75 21.21,34.67 20.32,35.56 v3(17.91,35.56)
  Bottom Layer w0.203: v3(17.91,35.56) v3(16.26,35.56)
LED3: length 14.4
  Top Layer w0.203: v3(17.91,33.53) 20.32,33.53 20.83,33.02 20.83,31.37 21.59,30.61 U1.3 ; R4.2 12.96,33.53 v3(16.26,33.53)
  Bottom Layer w0.203: v3(17.91,33.53) v3(16.26,33.53)
LED4: length 15.2
  Top Layer w0.203: U1.7 18.51,28.61 v3(17.91,29.21) ; v3(16.26,31.5) 12.96,31.5 R5.2 11.95,32.83 v3(11.94,32.83)
  Bottom Layer w0.203: v3(17.91,29.21) 17.91,30.99 17.4,31.5 v3(16.26,31.5) ; v3(11.94,32.83) R14.1
LEDJ: length 20.4
  Top Layer w0.203: U0.10 10.29,11.12 10.29,15.24 11.94,16.89 v3(11.94,18.29) ; v3(11.94,29.84) 11.94,30.47 R1.2
  Bottom Layer w0.203: v3(11.94,18.29) v3(11.94,29.84)
RST: length 54.8
  Top Layer w0.203: U1.24 26.59,20.11 v3(26.8,20.32) ; RST.4 RST.3 v3(53.47,10.99) 47.17,10.99 R6.1
  Bottom Layer w0.203: v3(53.47,10.99) 51.37,8.89 27.31,8.89 26.8,9.4 v3(26.8,20.32)
SD_CD: length 28.8
  Top Layer w0.203: v3(35.05,16.38) 32.38,16.38 31.54,15.54 U1.49
  Bottom Layer w0.203: R25.1 51.31,22.49 51.31,19.69 50.88,19.25 TF.9 47.7,19.25 44.83,16.38 v3(35.05,16.38)
SD_CLK: length 18.3
  Top Layer w0.203: v3(33.53,14.86) 33.04,14.37 U1.52
  Bottom Layer w0.203: v3(33.53,14.86) 33.53,14.85 TF.5
SD_CMD: length 36.6
  Top Layer w0.203: U1.46 v3(30.04,10.54)
  Bottom Layer w0.203: R22.1 54.99,15.49 52.15,12.65 TF.3 47.71,12.65 45.59,10.54 v3(30.04,10.54)
SD_D0: length 29
  Top Layer w0.203: v3(34.04,15.37) 33.15,15.37 32.54,14.76 U1.51
  Bottom Layer w0.203: v3(34.04,15.37) 46.1,15.37 47.79,17.05 TF.7 50.58,17.05 53.47,19.94 R23.1
SD_D1: length 28.6
  Top Layer w0.203: U1.50 32.04,15.15 32.77,15.88 v3(34.54,15.88)
  Bottom Layer w0.203: R24.1 51.94,19.18 50.92,18.15 TF.8 47.75,18.15 45.47,15.88 v3(34.54,15.88)
SD_D2: length 42.2
  Top Layer w0.203: U1.42 v3(28.04,9.53)
  Bottom Layer w0.203: R20.1 58.04,17.02 51.48,10.45 TF.1 48.13,9.53 v3(28.04,9.53)
SD_D3: length 39.6
  Top Layer w0.203: U1.44 v3(29.04,10.03)
  Bottom Layer w0.203: R21.1 56.51,16.26 51.81,11.55 49.19,11.55 ; v3(29.04,10.03) 46.23,10.03 47.75,11.56 49.18,11.56 49.19,11.55 ; 49.19,11.55 TF.2
SWCLK: length 6
  Top Layer w0.203: v2(12.7,8.89) 13.84,8.89 16.39,6.35 U0.20
SWDIO: length 7.1
  Top Layer w0.203: v2(10.92,8.89) 12.19,7.62 14.48,7.62 15.74,6.36 U0.19
U0_5V: length 10.3
  Top Layer w0.508: v1(9.27,9.02) 8.9,9.39 USB0.A4B9 ; USB0.B4A9 8.9,4.58 v1(9.27,4.95)
  Bottom Layer w0.508: v1(9.27,4.95) v1(9.27,9.02) D0.2
U1_5V: length 10.3
  Top Layer w0.508: v1(9.27,40.77) 8.9,41.14 USB1.A4B9 ; v1(9.27,36.7) 8.9,36.33 USB1.B4A9
  Bottom Layer w0.508: v1(9.27,40.77) v1(9.27,36.7) D1.2
USB0_D+: length 12.5
  Top Layer w0.203: USB0.B6 6.34,6.23 6.1,6.48 6.1,6.98 6.35,7.23 USB0.A6 14.23,7.23 15.09,6.38 U0.18
USB0_D-: length 11.9
  Top Layer w0.203: USB0.A7 14.09,6.73 14.44,6.39 U0.17 ; v3(8.51,6.22) 8.51,6.73 ; v3(8.51,7.87) 8.37,7.73 USB0.B7
  Bottom Layer w0.203: v3(8.51,7.87) v3(8.51,6.22)
USB1_D+: length 31.7
  Top Layer w0.203: U1.10 11.37,27.11 10.92,27.56 10.92,37.97 9.91,38.99 7.34,38.99 USB1.A6 6.35,38.98 6.1,38.73 6.1,38.23 6.34,37.98 USB1.B6 ; v3(11.43,31.5) 10.92,31.5
  Bottom Layer w0.203: R14.2 11.68,31.5 v3(11.43,31.5)
USB1_D-: length 30.8
  Top Layer w0.203: USB1.A7 7.34,38.48 9.65,38.48 10.41,37.72 10.41,27.31 11.11,26.61 U1.11 ; USB1.B7 8.37,39.48 v3(8.51,39.62) ; v3(8.51,37.97) 8.51,38.48
  Bottom Layer w0.203: v3(8.51,39.62) v3(8.51,37.97)
VB4: length 44.2
  Top Layer w0.305: v2(29.21,5.21) 21.97,5.21 20.83,4.06 19.3,4.06 PB4.3 ; C36.2 v2(44.45,6.1) ; U1.56 35.04,13.96 35.56,14.48 37.47,14.48 38.04,13.9 U1.62 38.04,10.86 38.35,10.54 v2(38.35,6.1)
  Bottom Layer w0.305: v2(44.45,6.1) v2(38.35,6.1) 30.1,6.1 v2(29.21,5.21)
VB567: length 66.3
  Top Layer w0.305: U1.122 36.54,31.91 36.83,31.62 38.99,31.62 ; 38.99,31.62 39.04,31.67 U1.117 ; 38.99,31.62 42.42,28.19 42.42,24.1 ; v2(57.91,33.4) 57.91,27.94 57.42,27.44 FPC.22 v2(53.56,27.44) 52.38,27.44 ; 52.38,27.44 C7.2 ; 52.38,27.44 52.88,26.94 FPC.23 ; 42.42,24.1 42.42,24.11 U1.93 v2(47.26,24.11) R29.2 ; 42.42,24.1 42.42,18.11 ; C38.2 44.96,7.87 43.94,8.89 43.94,13.21 43.56,13.59 42.8,13.59 42.42,13.97 42.42,18.11 ; 42.42,18.11 42.42,18.11 U1.81
  Bottom Layer w0.305: J2.1 v2(57.91,33.4) J1.2 ; v2(47.26,24.11) 47.26,26.81 47.89,27.44 v2(53.56,27.44)
$1N9749: length 12.6
  Top Layer w0.203: U1.9 v3(25.11,27.61) ; R27.1 23.24,36.2 v3(23.24,34.54)
  Bottom Layer w0.203: v3(23.24,34.54) 23.24,28.19 23.82,27.61 v3(25.11,27.61)
$1N9754: length 14.4
  Top Layer w0.203: v3(22.22,34.54) 22.22,35.17 R28.1 ; U1.14 v3(25.11,25.11)
  Bottom Layer w0.203: v3(22.22,34.54) 22.22,25.65 22.77,25.11 v3(25.11,25.11)
$1N9991: length 3.5
  Top Layer w0.203: U1.92 45.99,23.61 47.49,22.11 R29.1
$1N22061: length 6.4
  Top Layer w0.203: R13.1 5.34,40.5 5.86,39.98 USB1.A5
$1N22062: length 10.1
  Top Layer w0.203: R12.1 3.94,44.57 3.94,38.86 5.81,36.98 USB1.B5
$1N30391: length 17.1
  Bottom Layer w0.508: D1.1 D0.1
$2N2331: length 4.3
  Top Layer w0.203: R8.2 19.81,10.54 19.48,10.87 U0.1
$2N2337: length 6.7
  Top Layer w0.203: C9.2 R9.1 16.25,8.26 14.44,10.07 U0.4
$2N3716: length 2
  Top Layer w0.508: R4.1 15.45,34.54 LED3.2
$2N19061: length 2
  Top Layer w0.508: R1.1 15.45,30.48 JTAG.2
$2N19130: length 2
  Top Layer w0.508: LED1.2 15.45,38.61 R2.1
$2N19202: length 2
  Top Layer w0.508: R3.1 15.45,36.58 LED2.2
$2N19326: length 2
  Top Layer w0.508: R5.1 15.45,32.51 LED4.2
$2N27195: length 2
  Top Layer w0.508: PWR.2 15.45,28.45 R0.1
$2N28548: length 3.2
  Top Layer w0.203: R17.2 13.98,13.22 12.49,11.72 U0.7
$2N28577: length 2.7
  Top Layer w0.203: U0.8 11.84,12.34 12.7,13.21 R18.2
$2N28606: length 2.3
  Top Layer w0.203: 11.19,10.87 11.19,13.21 R19.2
$2N30524: length 9.6
  Top Layer w0.203: USB0.A5 5.82,8.23 3.94,6.35 3.94,1.15 R11.1
$2N30525: length 5.9
  Top Layer w0.203: USB0.B5 5.87,5.23 5.34,4.71 R10.1

## Text on the board
Bottom Silkscreen Layer: SWD | SWC | 2.5V | 3.3V | IO42 => SD_D2    IO1  => LED1 / IO44 => SD_D3    IO2  => LED2 / IO46 => SD_CMD   IO3  => LED3 / IO49 => SD_CD    IO7  => LED4 / IO50 => SD_D1    IO7  => USB_PU / IO51 => SD_D0    IO24 => RST / IO52 => SD_CLK   IO25 => BTN | VB567
Top Silkscreen Layer: 3V3 | VB4 | 2V5 | 5V | 54 | 55 | 58 | 59 | 60 | 64 | 65 | 66 | 67 | 68 | 69 | 70 | 71 | GND | 72 | 144 | 143 | 142 | 141 | 138 | 137 | 136 | 135 | 133 | 132 | 129 | 128 | EP4CE144
